# EasyEDA Pro project 3SE_24_Power_Rune.eprj, board 深大PCB参考 (continued)
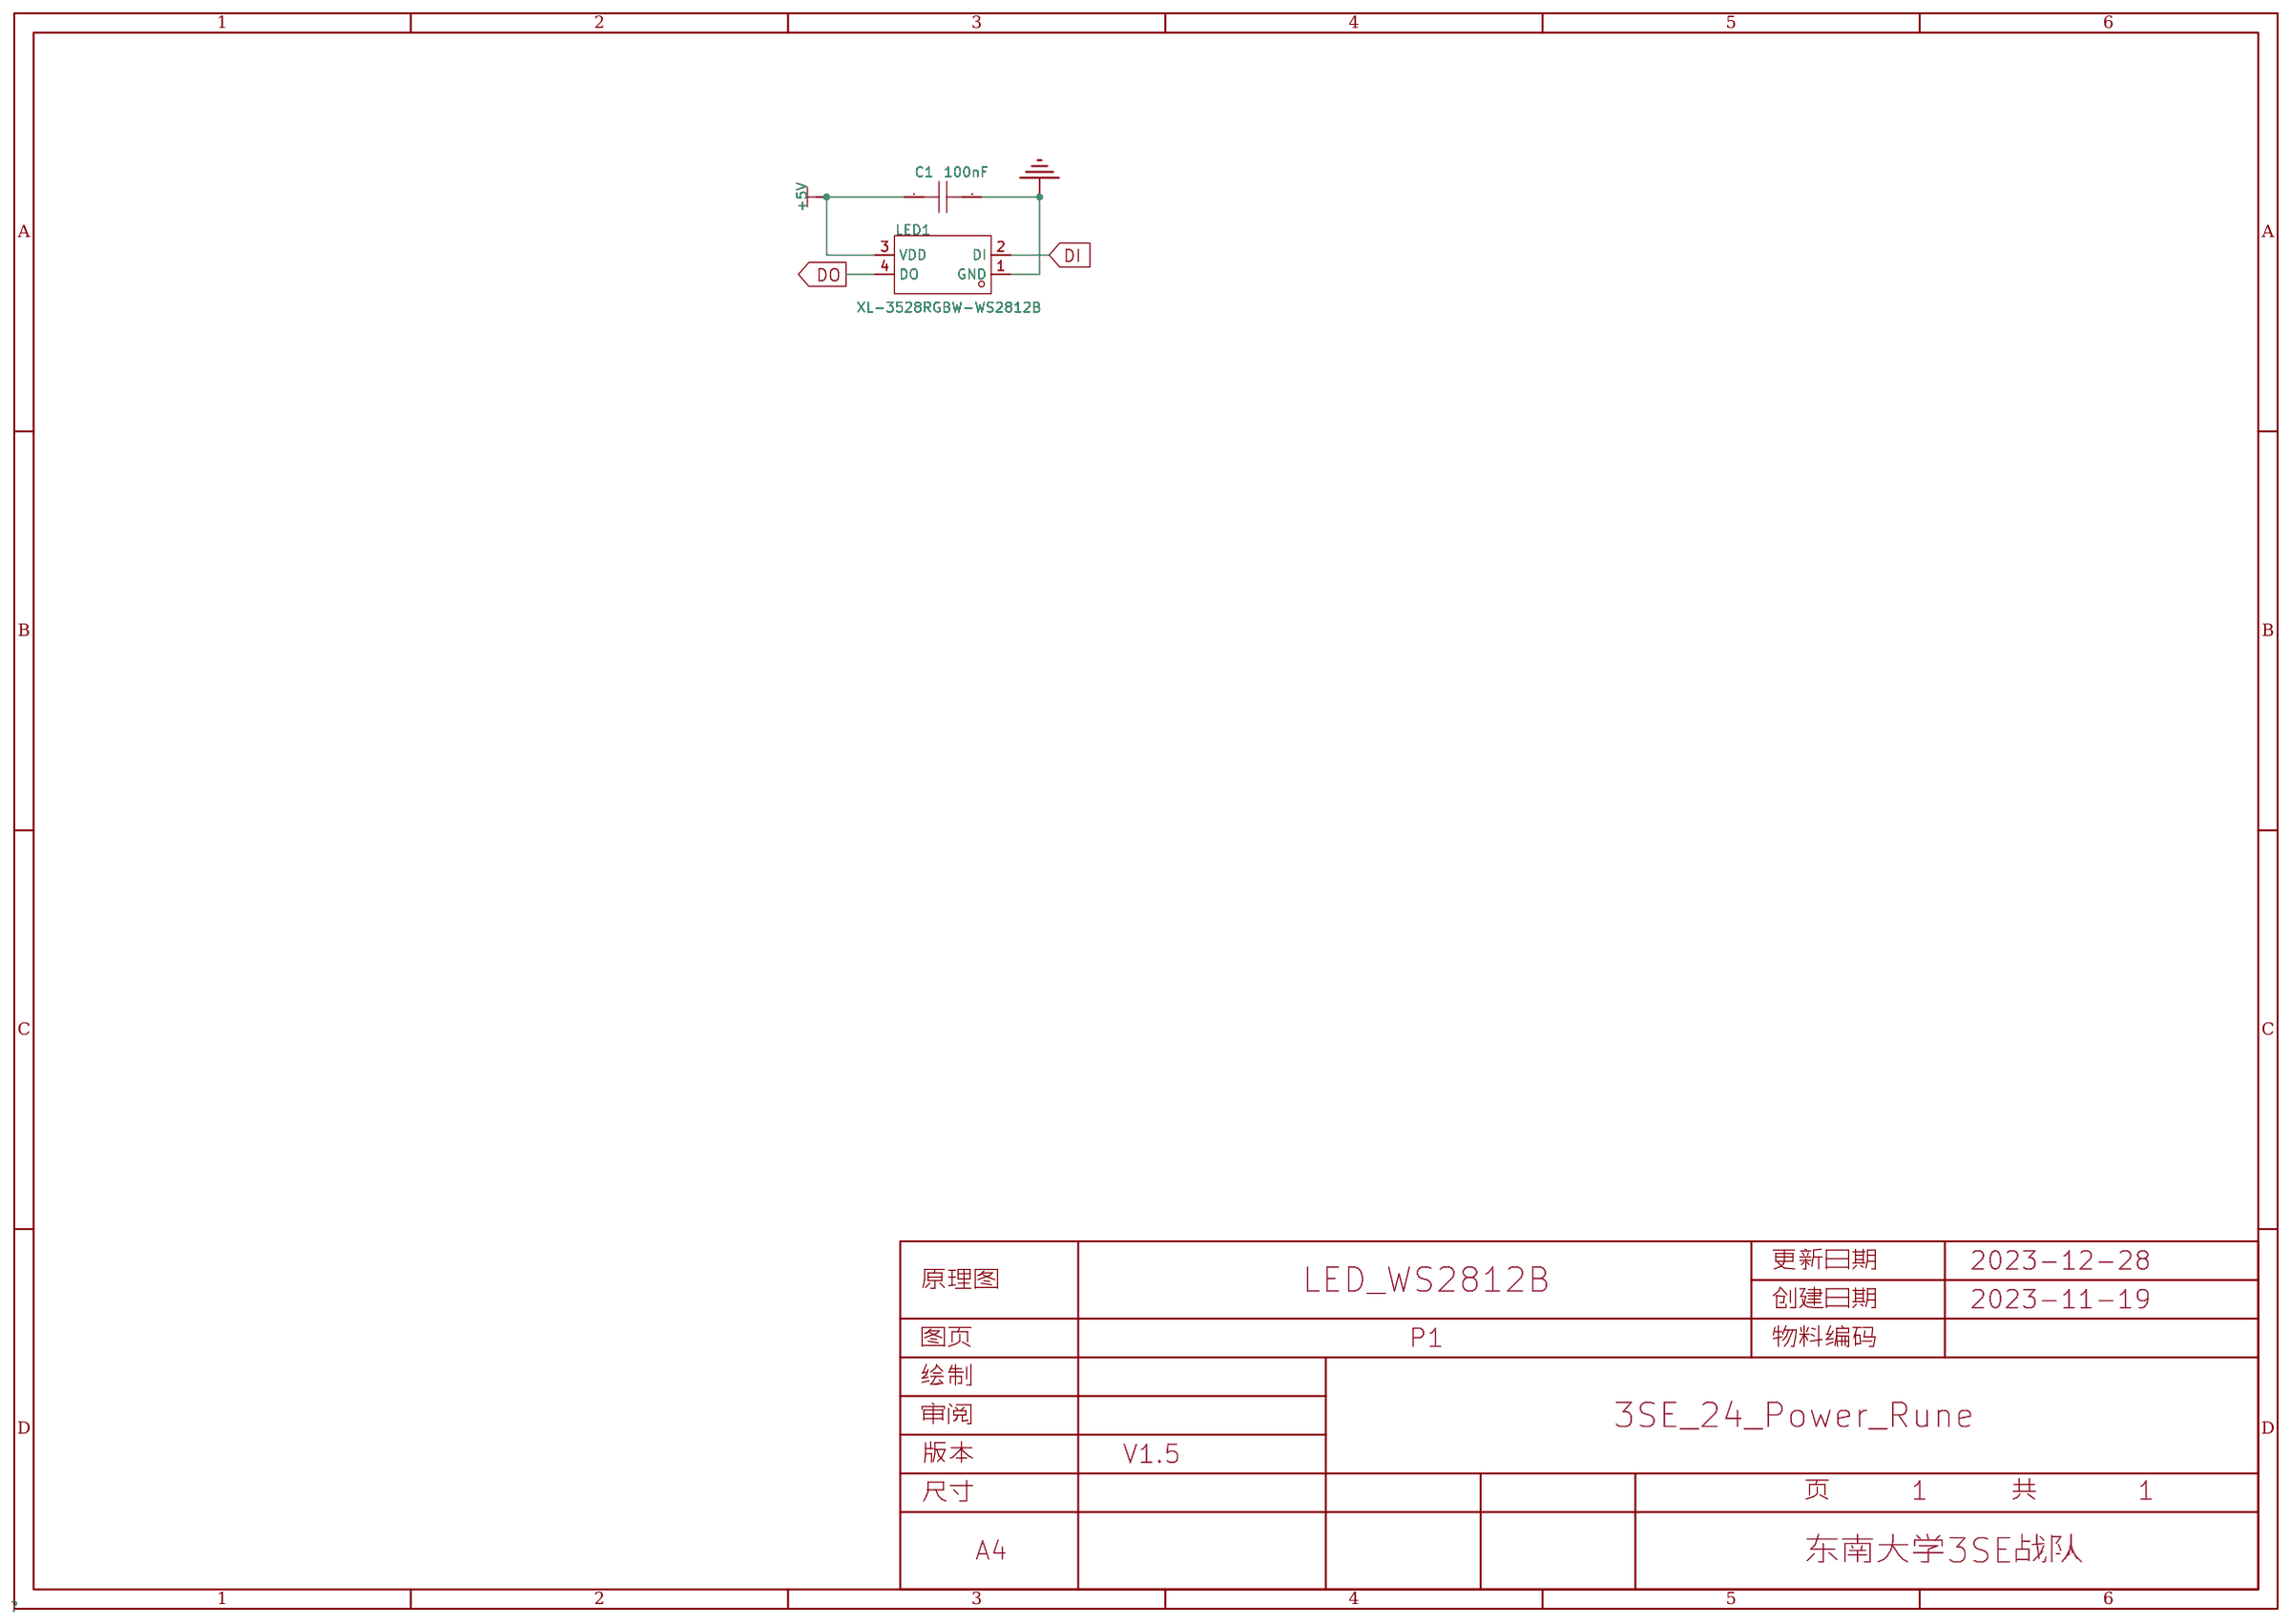
[diagram p0: schematic sheet]
## Routing (per net, layer and track width the routed paths; a pad name or vN(x,y) marks a point on that pad's centre or on a via; arc(x,y) is an arc through that point) (continued)
NETD235_2: length 15.8
  Top Layer w0.254: 73.91,122.18 74.63,122.19 85.65,113.04 D236.4
NETD236_2: length 18.8
  Top Layer w0.381: 84.73,107.48 84.9,107.64 94.29,107.64 98.5,103.43 98.5,100.45 D237.4
NETD237_2: length 15.8
  Top Layer w0.254: D238.4 111.31,88.89 98.2,94.65 D237.2
NETD238_2: length 15.8
  Top Layer w0.254: D239.4 126.41,79.72 112.62,83.6 D238.2
NETD239_2: length 17.4
  Top Layer w0.254: 144.86,73.33 144.31,72.85 128.45,74.66 D239.2
NETD240_2: length 17.3
  Top Layer w0.254: 146.48,67.65 147.03,68.12 162.92,67.81 D241.4
NETD241_2: length 17.5
  Top Layer w0.254: D242.4 182.25,65.07 166.27,63.51 D241.2
NETD242_2: length 11.2
  Top Layer w0.254: D242.2 186.3,61.42 194.87,66.08 D243.4
NETD243_2: length 18.7
  Top Layer w0.254: D244.4 216.82,64.01 199.35,62.17 D243.2
NETD244_2: length 10.4
  Top Layer w0.254: D245.4 229.24,73.85 221.9,68.79 D244.2
NETD245_2: length 15.9
  Top Layer w0.254: 245.38,82.07 245.37,81.34 234.36,71.98 D245.2
NETD246_2: length 15.6
  Top Layer w0.254: 260.06,91.51 260.14,90.79 250.7,80.2 250.69,79.48
NETD247_2: length 24.3
  Top Layer w0.254: D248.4 278.48,104.48 278.49,104.45 278.54,102.57 arc(278.16,100.64) 276.97,99.08 265.96,89.92 D247.2
NETD248_2: length 9.6
  Top Layer w0.254: D249.4 285.18,115.6 283.14,107.76 D248.2
NETD249_2: length 15.8
  Top Layer w0.254: D249.2 290.51,116.72 294.87,130.37 D250.4
NETD250_2: length 15.8
  Top Layer w0.254: D251.4 302.41,146.34 300,132.22 D250.2
NETD251_2: length 15.8
  Top Layer w0.254: D251.2 307.23,148.89 307.65,163.21 D252.4
NETD252_2: length 24.9
  Top Layer w0.254: D252.2 312.07,166.41 311.35,189.87 D253.4
NETD253_2: length 13.5
  Top Layer w0.254: 315.63,193.55 315.01,193.92 309.6,204.74 D254.4
NETD254_2: length 18.2
  Top Layer w0.254: D254.2 314.2,209.12 313.94,225.84 D255.4
NETD255_2: length 9.1
  Top Layer w0.254: D256.4 303.27,235.85 309.16,230.92 D255.2
NETD256_2: length 12.9
  Top Layer w0.254: D256.2 305.32,240.91 297.5,249.22 D257.4
NETD257_2: length 15.8
  Top Layer w0.254: D258.4 288.47,264.41 298.82,254.51 D257.2
NETD258_2: length 12.9
  Top Layer w0.254: D258.2 289.05,269.83 278.95,275.29 D259.4
NETD259_2: length 23
  Top Layer w0.254: D259.2 279.65,281 279.75,281.1 279.75,283.9 272.84,291.37 272.83,291.37 272.8,291.41 270.35,292.49 270.25,292.49 270.2,292.47 D260.4
NETD260_2: length 15.8
  Top Layer w0.254: 264.29,295.92 263.62,295.66 250.13,300.49 D261.4
NETD261_2: length 15.8
  Top Layer w0.254: 249.09,306.03 248.45,305.68 234.43,308.58 D262.4
NETD262_2: length 15.8
  Top Layer w0.254: D262.2 232.05,313.49 217.75,314.41 217.24,313.9
NETD263_2: length 15.8
  Top Layer w0.254: D263.2 214.71,318.94 200.43,317.86 D264.4
NETD264_2: length 12
  Top Layer w0.254: D265.4 186.55,319.23 196.79,321.92 D264.2
NETD265_2: length 19.2
  Top Layer w0.254: D265.2 182.51,322.88 165.63,317.45 D266.4
NETD266_2: length 10.9
  Top Layer w0.254: D267.4 151.36,320.8 160.8,321.57 D266.2
NETD267_2: length 18.4
  Top Layer w0.254: D268.4 131.78,307.22 146.27,316.02 D267.2
NETD268_2: length 16
  Top Layer w0.254: D269.4 115.95,298.77 126.54,308.73 D268.2
NETD269_2: length 15.8
  Top Layer w0.254: D270.4 101.8,288.21 110.55,299.54 D269.2
NETD270_2: length 18.4
  Top Layer w0.254: 89.48,275.09 88.18,278.86 88.17,278.9 88.17,278.97 89.66,284.98 89.72,285.04 94.15,289.03 94.26,289.03 D270.2
NETD271_2: length 15.8
  Top Layer w0.254: 83.61,275.71 83.85,275.02 78.55,261.72 D272.4
NETD272_2: length 15.8
  Top Layer w0.254: 70.33,245.71 69.92,246.31 73.31,260.22 D272.2
NETD273_2: length 15.8
  Top Layer w0.254: 64.51,244.69 64.93,244.1 64.04,229.79 64.53,229.26
NETD274_2: length 15.7
  Top Layer w0.254: 58.91,227.44 59.41,226.91 59.46,212.65 D275.4
NETD275_2: length 25.4
  Top Layer w0.254: D276.4 74.22,194.56 55.27,209.15 D275.2
NETD276_2: length 14
  Top Layer w0.254: D276.2 70.56,190.51 74.68,177.92
NETD277_2: length 13.4
  Top Layer w0.254: 70.8,160.82 71,161.52 69.78,173.42 D277.2
NETD278_2: length 15.6
  Top Layer w0.254: D279.4 83.82,144.8 75.77,156.43 D278.2
NETD279_2: length 15.6
  Top Layer w0.254: D280.4 92.52,129.68 82.4,139.54 D279.2
NETD280_2: length 26.4
  Top Layer w0.254: D281.4 109.49,110.83 109.48,110.79 109.41,110.72 104.7,109.35 arc(103.02,109.38) 101.65,110.37 91.45,123.89 D280.2
NETD281_2: length 13.2
  Top Layer w0.254: D281.2 109.36,105.74 120.85,103.38 121.52,103.66
NETD282_2: length 11.3
  Top Layer w0.254: D283.4 131.49,95.38 121.97,98.04 121.31,97.76
NETD283_2: length 15.2
  Top Layer w0.254: 132.82,89.91 133.43,90.29 146.99,87.75 147.54,88.23
NETD284_2: length 15.6
  Top Layer w0.254: D285.4 163.84,83.21 149.71,83.02 149.16,82.55
NETD285_2: length 16.8
  Top Layer w0.254: D286.4 182.38,81.46 167.27,78.97 D285.2
NETD286_2: length 14.9
  Top Layer w0.254: D286.2 186.43,77.8 199.11,82.14 199.38,82.82
NETD287_2: length 13.3
  Top Layer w0.254: 203.4,78.49 203.87,77.94 215.68,79.25 D288.4
NETD288_2: length 15.7
  Top Layer w0.254: D288.2 220.76,84.03 232.48,92.08 232.53,92.8
NETD289_2: length 17
  Top Layer w0.381: 248.81,102.23 248.89,101.6 237.72,90.57 D289.2
NETD290_2: length 22
  Top Layer w0.381: D291.4 264.94,117.53 263.23,117.22 arc(263.13,117.19) 263.04,117.13 260.16,114.48 arc(260.1,114.42) 260.06,114.35 254.28,100.84 D290.2
NETD291_2: length 10.3
  Top Layer w0.381: D291.2 271.18,116.83 273.29,125.64 D292.4
NETD292_2: length 14.5
  Top Layer w0.381: 281.55,139.93 281.91,139.4 278.65,126.59 278.92,126.01
NETD293_2: length 15.6
  Top Layer w0.381: D294.4 289.02,155.33 287.06,141.18 D293.2
NETD294_2: length 15.6
  Top Layer w0.381: 293.05,172.56 293.55,172.17 293.83,157.89 D294.2
NETD295_2: length 15.6
  Top Layer w0.381: D296.4 295.39,189.51 297.9,175.45 298.4,175.06
NETD296_2: length 15.7
  Top Layer w0.381: 293.88,207.28 294.48,207.06 299.17,193.43 D296.2
NETD297_2: length 11.6
  Top Layer w0.381: 298.2,211.31 298.7,211.7 297.98,221.98 D298.4
NETD298_2: length 17.2
  Top Layer w0.381: D299.4 284.65,240.29 293.24,226.94 D298.2
NETD299_2: length 15.6
  Top Layer w0.381: D299.2 286.24,245.5 275.94,255.4 D300.4
NETD300_2: length 10.5
  Top Layer w0.381: D300.2 276.7,260.79 268.29,264.56 D301.4
NETD301_2: length 24.8
  Top Layer w0.381: D301.2 269.48,270.55 269.58,270.65 270.14,272.59 270.14,272.76 arc(267.44,275.79) 263.95,277.88 254.51,281.74 254.35,281.74 254.27,281.7 D302.4
NETD302_2: length 15.6
  Top Layer w0.381: D302.2 251.08,286.01 237.41,290.16 D303.4
NETD303_2: length 15.6
  Top Layer w0.381: D303.2 235.63,295.31 221.48,297.27 D304.4
NETD304_2: length 15.5
  Top Layer w0.381: D305.4 204.71,301.86 218.92,302.08 219.39,302.52
NETD305_2: length 16.3
  Top Layer w0.381: D306.4 186.62,303.8 201.43,306.21 D305.2
NETD306_2: length 15
  Top Layer w0.381: 183.01,308.14 182.7,307.58 169.88,302.75 169.66,302.15
NETD307_2: length 11.4
  Top Layer w0.381: 154.47,307.03 155.09,306.87 165.24,306.98 D307.2
NETD308_2: length 17.7
  Top Layer w0.381: 150.59,302.57 150.13,302.13 136.52,292.9 D309.4
NETD309_2: length 15.6
  Top Layer w0.381: D309.2 131.31,294.49 121.41,284.2 D310.4
NETD310_2: length 11
  Top Layer w0.381: D311.4 111.43,276.4 116.02,284.95 115.94,285.59
NETD311_2: length 21.2
  Top Layer w0.381: D312.4 95.73,261.21 95.69,261.28 95.69,261.45 101.65,274.34 101.72,274.41 105.19,276.99 105.34,276.99 105.37,276.98 D311.2
NETD312_2: length 15.6
  Top Layer w0.381: D313.4 86.64,245.66 90.8,259.34 D312.2
NETD313_2: length 15.6
  Top Layer w0.381: 81.14,244.42 81.5,243.89 79.54,229.74 D314.4
NETD314_2: length 15.6
  Top Layer w0.381: D315.4 75,212.89 74.73,227.18 D314.2
NETD315_2: length 24.6
  Top Layer w0.381: D316.4 88.25,194.24 70.66,209.61 70.15,210.01
NETD316_2: length 14.3
  Top Layer w0.381: D316.2 84.47,190.32 89.49,178.33 D317.4
NETD317_2: length 9.4
  Top Layer w0.381: D317.2 85.37,173.6 84.41,165.5 D318.4
NETD318_2: length 19.9
  Top Layer w0.381: 88.72,161 89.16,160.54 100.46,145.78 D319.4
NETD319_2: length 15.4
  Top Layer w0.381: D319.2 99.22,140.48 110.12,131.5 D320.4
NETD320_2: length 18
  Top Layer w0.381: D321.4 120.53,118.49 120.46,118.46 120.37,118.46 113.23,119.26 113.12,119.36 108.98,124.1 108.98,124.28 108.98,124.3 D320.2
NETD321_2: length 15.4
  Top Layer w0.381: 122.28,113.52 122.87,113.76 136.23,109.18 D322.4
NETD322_2: length 16.2
  Top Layer w0.381: D323.4 152.72,102.53 137.89,103.99 D322.2
NETD323_2: length 14.5
  Top Layer w0.381: D324.4 168.51,97.46 155.28,97.72 154.81,97.28
NETD324_2: length 12.3
  Top Layer w0.381: 171.51,92.68 171.89,93.19 182.44,96.25 D325.4
NETD325_2: length 14.4
  Top Layer w0.381: D325.2 186.36,92.47 198.79,96.82 D326.4
NETD326_2: length 18.3
  Top Layer w0.381: D327.4 218.5,102.27 203.55,94.19 D326.2
NETD327_2: length 13.6
  Top Layer w0.381: 223.52,99.7 223.58,100.33 232.65,108.7 D328.4
NETD328_2: length 14.6
  Top Layer w0.381: D329.4 246.2,118.25 238.01,107.71 D328.2
NETD329_2: length 20.8
  Top Layer w0.381: D329.2 254.6,117.7 254.74,117.71 257.62,120.46 257.68,120.53 260.91,130.72 260.91,130.86 260.88,130.94 259.65,133.56
NETD330_2: length 15.7
  Top Layer w0.381: D331.4 269.85,147.62 265.29,133.93 D330.2
NETD331_2: length 21
  Top Layer w0.381: 276.87,169.54 277.33,169.09 274.95,149.51 D331.2
NETD332_2: length 19.8
  Top Layer w0.381: D333.4 280.56,190.32 282.02,171.86 D332.2
NETD333_2: length 10.9
  Top Layer w0.381: 279.39,203.12 279.98,202.86 284.34,194.24 D333.2
NETD334_2: length 12.2
  Top Layer w0.381: 283.98,206.84 284.51,207.2 283.63,218.04 283.79,218.66
NETD335_2: length 11.4
  Top Layer w0.381: D335.2 278.89,223 272.68,231.04 D336.4
NETD336_2: length 15.7
  Top Layer w0.381: D337.4 264.57,246.84 274.39,236.21 D336.2
NETD337_2: length 27.2
  Top Layer w0.381: 265.96,252.31 265.33,252.23 254.98,266.21 arc(254.88,266.3) 254.76,266.35 252.95,266.8 arc(252.86,266.81) 252.76,266.8 246.75,265.13 D338.4
NETD338_2: length 14
  Top Layer w0.381: D339.4 234.27,273.82 246.53,270.57 D338.2
NETD339_2: length 15.7
  Top Layer w0.381: D339.2 233.09,279.14 218.86,281.46 D340.4
NETD340_2: length 15.6
  Top Layer w0.381: D341.4 202.4,286.28 216.75,286.48 D340.2
NETD341_2: length 14.6
  Top Layer w0.381: 199.85,291.32 199.42,290.84 186.36,288.18 D342.4
NETD342_2: length 9.7
  Top Layer w0.381: D343.4 175,287.97 182.44,291.96 D342.2
NETD343_2: length 13.5
  Top Layer w0.381: D344.4 158.26,292.4 170.46,292.3 D343.2
NETD344_2: length 15.8
  Top Layer w0.381: D345.4 141.99,278.48 153.3,287.65 D344.2
NETD345_2: length 15.4
  Top Layer w0.381: 136.75,280.59 136.75,279.95 127.28,269.47 D346.4
NETD346_2: length 19.9
  Top Layer w0.381: D347.4 115.07,255.09 115.11,255.08 115.29,255.08 119.31,258.51 119.39,258.59 122.24,267.64 122.24,267.73 122.24,267.76 D346.2
NETD347_2: length 13.1
  Top Layer w0.381: D348.4 103.82,244.39 107.65,255.61 107.44,256.21
NETD348_2: length 15.4
  Top Layer w0.381: D348.2 98.56,242.97 95.81,229.12 D349.4
NETD349_2: length 15.4
  Top Layer w0.381: 91.16,212.26 90.66,212.66 90.89,226.78 90.48,227.26
NETD350_2: length 23.8
  Top Layer w0.381: D351.4 102.98,194.36 86.24,209.48 D350.2
NETD351_2: length 17.6
  Top Layer w0.381: D352.4 98,174.14 98.08,190.45 D351.2
NETD352_2: length 12.5
  Top Layer w0.381: D353.4 109.41,161.29 107.23,161.41 arc(107.05,161.46) 106.92,161.6 102.75,169.18 D352.2
NETD353_2: length 15.3
  Top Layer w0.381: D354.4 117.61,146.34 107.55,156.17 D353.2
NETD354_2: length 19.7
  Top Layer w0.381: D355.4 131.86,132.7 132.1,132.95 132.1,133.58 127.96,137.72 127.88,137.75 118.55,141.14 118.46,141.14 118.44,141.14 D354.2
NETD355_2: length 12.5
  Top Layer w0.381: D355.2 131.64,126.57 142.3,123.08 142.84,123.41
NETD357_2: length 11.6
  Top Layer w0.381: 158.17,112.1 158.63,112.53 168.94,113.08 169.3,113.61
NETD358_2: length 11.5
  Top Layer w0.381: D359.4 182.44,110.86 172.44,108.91 172.07,108.39
NETD359_2: length 21
  Top Layer w0.381: D359.2 186.36,107.08 206.1,108.04 D360.4
NETD360_2: length 16.6
  Top Layer w0.381: 210.6,112.34 211.06,112.78 223.85,121.25 D361.4
NETD361_2: length 11.7
  Top Layer w0.381: D361.2 229.13,119.93 235.22,128.41 D362.4
NETD362_2: length 21.7
  Top Layer w0.381: D363.4 250.69,140.94 250.73,140.86 250.73,140.71 247.4,131.07 247.33,131.01 243.41,127.47 243.25,127.47 243.24,127.47 D362.2
NETD363_2: length 15.3
  Top Layer w0.381: D363.2 254.92,144.32 258.41,157.94 D364.4
NETD364_2: length 15.3
  Top Layer w0.381: 263.84,159.48 263.46,159.99 264.04,174.04 D365.4
NETD365_2: length 14.8
  Top Layer w0.381: D366.4 266.21,190.45 268.56,177.09 269.04,176.67
NETD366_2: length 14.4
  Top Layer w0.381: 271.6,208.12 271.44,207.5 271.11,194.36 270.55,194.06
NETD367_2: length 13.8
  Top Layer w0.381: D368.4 259.9,223.03 266.7,212.46 D367.2
NETD368_2: length 16.2
  Top Layer w0.381: D369.4 251.71,239.24 261.76,228.14 D368.2
NETD369_2: length 24.6
  Top Layer w0.381: 252.46,244.63 D369.2 252.92,244.96 245.69,254.91 arc(245.61,255) 245.49,255.05 ; 245.49,255.05 240.84,256.4 arc(240.79,256.41) 240.74,256.41 236.83,256.41 arc(235.84,256) D370.4
NETD370_2: length 16.3
  Top Layer w0.381: 222.49,263.19 D371.4 233.2,262.86 arc(234.17,262.67) 234.99,262.12 D370.2 235.65,260.65
NETD371_2: length 18.3
  Top Layer w0.381: D371.2 220.99,268.43 204.23,271.15 D372.4
NETD372_2: length 16.8
  Top Layer w0.381: D372.2 201.67,275.96 186.36,273.66 D373.4
NETD373_2: length 7.9
  Top Layer w0.381: 182.75,278 182.45,277.44 177.03,273.66 D374.4
NETD374_2: length 11.4
  Top Layer w0.381: D374.2 172.67,277.61 162.33,276.52 D375.4
NETD375_2: length 15.7
  Top Layer w0.381: 157.83,272.22 157.37,271.78 145.4,263.78 145.42,263.14
NETD376_2: length 13
  Top Layer w0.381: D377.4 132.9,255.81 140.12,265.1 D376.2
NETD377_2: length 18.6
  Top Layer w0.381: D378.4 118.99,243.85 118.96,243.92 118.96,244.07 121.64,252.16 121.71,252.23 121.72,252.23 126.63,256.65 126.78,256.65 126.79,256.65 D377.2
NETD378_2: length 15.3
  Top Layer w0.381: D378.2 114.4,241.25 110.91,227.63 D379.4
NETD379_2: length 15.3
  Top Layer w0.381: D380.4 105.27,211.53 105.86,225.59 105.47,226.1
NETD380_2: length 24.1
  Top Layer w0.381: 100.28,208.91 100.76,208.49 118.68,194.36 D381.4
NETD381_2: length 18.5
  Top Layer w0.381: D381.2 113.88,190.44 113.88,173.12 D382.4
NETD382_2: length 10.5
  Top Layer w0.381: 118.18,168.62 118.62,168.16 125.8,162.43 126.44,162.43
NETD383_2: length 10.8
  Top Layer w0.381: D384.4 132.49,152.17 124.38,157.17 D383.2
NETD384_2: length 21.5
  Top Layer w0.381: D384.2 131.28,144.94 131.26,144.89 131.26,144.71 133.93,140.88 134.02,140.79 146.12,137.26 146.27,137.26 146.36,137.31 D385.4
NETD385_2: length 14.8
  Top Layer w0.381: D385.2 148.72,132.61 162.11,130.39 D386.4
NETD386_2: length 14.9
  Top Layer w0.381: D387.4 178.2,126.79 164.67,125.58 D386.2
NETD387_2: length 13.7
  Top Layer w0.381: D387.2 181.87,122.77 193.49,127.22 D388.4
NETD388_2: length 13.9
  Top Layer w0.381: D389.4 210.8,124.8 198.26,123.14 D388.2
NETD389_2: length 15.3
  Top Layer w0.381: D390.4 224.71,140.28 215.76,129.54 215.3,129.1
NETD390_2: length 18.5
  Top Layer w0.381: 236.6,152.65 237.87,149.93 237.91,149.86 237.91,149.74 236.6,142.26 236.51,142.16 232.28,138.67 232.09,138.67 232.03,138.68 D390.2
NETD391_2: length 14.6
  Top Layer w0.381: D391.2 242.23,153.02 244.77,166.12 D392.4
NETD392_2: length 14.9
  Top Layer w0.381: D392.2 249.73,168.37 249.37,181.95 D393.4
NETD393_2: length 15.1
  Top Layer w0.381: D393.2 253.62,185.36 249.13,198.39 D394.4
NETD394_2: length 10.6
  Top Layer w0.381: D395.4 254.3,212.2 253.5,202.89 252.99,202.52
NETD395_2: length 17.4
  Top Layer w0.381: D396.4 238.83,229.21 249.55,217.16 D395.2
NETD396_2: length 22.8
  Top Layer w0.381: D396.2 240.49,235.26 236.41,244.32 arc(236.31,244.45) 236.18,244.53 ; 236.18,244.53 231.75,245.97 arc(231.65,245.99) 231.55,245.98 225.27,244.63 224.67,244.4
NETD397_2: length 11.7
  Top Layer w0.381: D397.2 224.66,250.04 214.3,250.86 213.78,250.48
NETD398_2: length 14.9
  Top Layer w0.381: D398.2 212.37,255.95 198.78,257.29 D399.4
NETD399_2: length 11.1
  Top Layer w0.381: D400.4 186.61,257.82 195.64,261.73 D399.2
NETD400_2: length 18.2
  Top Layer w0.381: D400.2 182.39,262.47 165.5,261.66 D401.4
NETD401_2: length 13.8
  Top Layer w0.381: D401.2 160.54,256.92 150.96,248.89 151,248.25
NETD402_2: length 20.2
  Top Layer w0.381: D403.4 138.21,234.85 138.37,234.85 138.48,234.97 140.97,237.62 145.78,247.33 145.78,247.43 145.78,247.44 D402.2
NETD403_2: length 11.1
  Top Layer w0.381: D404.4 127.82,225.77 130.5,235.2 D403.2
NETD404_2: length 14.9
  Top Layer w0.381: D405.4 121.26,210.64 122.62,224.16 D404.2
NETD405_2: length 22.7
  Top Layer w0.381: 133.72,193.8 133.16,194.11 116.63,207.79 D405.2
NETD406_2: length 14.6
  Top Layer w0.381: D406.2 128.86,190.19 128.86,176.55 128.71,175.93
NETD407_2: length 12.9
  Top Layer w0.381: D408.4 141.99,163.51 133.61,171.59 D407.2
NETD408_2: length 17.7
  Top Layer w0.381: 147.05,158.96 149.32,159.09 149.49,159.09 149.61,158.96 149.62,158.95 153.8,153.83 153.8,153.67 153.79,153.65 D409.4 ; D408.2 141.02,158.42 141.07,158.45 143.47,158.75 147.05,158.96
NETD409_2: length 14.7
  Top Layer w0.381: D409.2 153.96,146.38 167.13,143.95 D410.4
NETD410_2: length 14.7
  Top Layer w0.381: D411.4 182.96,140.9 169.69,139.14 D410.2
NETD411_2: length 14.3
  Top Layer w0.381: D411.2 186.88,136.99 200,136.99 D412.4
NETD412_2: length 13
  Top Layer w0.381: 213.48,150.38 213.55,149.74 204.96,141.74 204.5,141.29
NETD413_2: length 17.4
  Top Layer w0.381: D414.4 226.51,158.21 226.55,158.14 226.55,158.04 226.19,153.07 226.07,152.95 219.84,148.26 219.68,148.26 219.66,148.26 D413.2
NETD414_2: length 14.7
  Top Layer w0.381: D414.2 230.69,161.71 233.11,174.87 232.68,175.34
NETD415_2: length 14.7
  Top Layer w0.381: D416.4 236.16,190.71 237.92,177.43 D415.2
NETD416_2: length 14
  Top Layer w0.381: D417.4 239.82,207.37 239.94,194.62 240.5,194.31
NETD417_2: length 13.1
  Top Layer w0.381: D417.2 235.07,212.33 227.32,221.3 226.69,221.22
NETD418_2: length 19.1
  Top Layer w0.381: D419.4 220.56,235.11 220.64,235.14 220.74,235.14 225.53,234.7 225.64,234.59 229.09,230.28 229.09,230.12 229.08,230.1 228.71,226.77
NETD419_2: length 15.1
  Top Layer w0.381: 216.36,238.95 216.23,238.91 215.79,238.68 202.19,240.86 D420.4
NETD420_2: length 14.7
  Top Layer w0.381: D420.2 199.63,245.67 186.36,243.91 D421.4
NETD421_2: length 14.3
  Top Layer w0.381: 182.75,248.25 182.44,247.69 169.44,247.31 168.82,247.47
NETD422_2: length 12.8
  Top Layer w0.381: D423.4 155.76,235.07 164.48,242.57 164.94,243.01
NETD423_2: length 18.4
  Top Layer w0.381: 144.65,223.39 146.96,223.11 146.99,223.1 147.14,223.1 151.74,226.87 151.75,226.88 151.87,227 151.87,227.18 150.78,236.06 150.67,236.16 150.65,236.18 D423.2
NETD424_2: length 14.7
  Top Layer w0.381: 138.75,223.6 139.02,223.02 136.2,209.94 136.64,209.47
NETD425_2: length 22.4
  Top Layer w0.381: 130.96,207.85 131.4,207.38 148.4,194.87 D426.4
NETD426_2: length 12.4
  Top Layer w0.381: 143.95,178.98 143.88,179.04 143.88,191.09 144.06,191.26
NETD427_2: length 19.1
  Top Layer w0.381: 162.07,166.77 162.18,166.65 162.18,165.01 162.97,164.22 ; D427.2 148.59,175.15 148.9,175.15 160.78,168.02 160.81,167.99 162.06,166.77
NETD428_2: length 11.2
  Top Layer w0.381: 173.05,159.05 173.01,159.05 172.5,158.53 162.31,158.53 162.15,158.37
NETD429_2: length 12
  Top Layer w0.381: 185.84,156.76 185.59,156.17 175.14,153.81 D429.2
NETD430_2: length 7.9
  Top Layer w0.381: D431.4 196.58,151.22 190,151.71 D430.2
NETD431_2: length 22.5
  Top Layer w0.381: 201.08,155.52 201.54,155.96 205.45,162.24 arc(205.48,162.31) 205.5,162.38 206.07,165.9 206.29,167.27 206.31,167.39 210.3,171.51 210.4,171.61 210.53,171.62 211.74,171.76 213.11,171.91 213.74,171.83
NETD432_2: length 11.2
  Top Layer w0.381: D433.4 220.95,181.95 219.37,172.2 D432.2
NETD433_2: length 9.3
  Top Layer w0.381: D433.2 225.47,185 220.8,191.55 D434.4
NETD434_2: length 9.8
  Top Layer w0.381: 224.06,196.16 224.52,196.6 224.96,205.09 D435.4
NETD435_2: length 25.7
  Top Layer w0.381: 220.66,209.58 220.21,210.05 216.09,221.57 arc(216,221.71) 215.86,221.8 209.68,223.86 arc(209.55,223.88) 209.43,223.86 ; 209.43,223.86 204.68,222.16 204.13,221.83
NETD436_2: length 13.5
  Top Layer w0.381: D437.4 190.71,227.6 203.6,227.6 D436.2
NETD437_2: length 15.2
  Top Layer w0.381: D438.4 172.56,232.54 187.6,232.54 D437.2
NETD438_2: length 23.1
  Top Layer w0.381: D439.4 156.25,212.82 162.72,214.81 ; 168.62,228.02 168.16,227.58 165.01,225.9 arc(164.88,225.79) 164.82,225.63 162.98,215.11 arc(162.89,214.93) 162.72,214.82
NETD439_2: length 10
  Top Layer w0.381: D439.2 150.08,214.29 150.08,205.93 150.99,205.02 D440.4
NETD440_2: length 19.5
  Top Layer w0.381: D440.2 145.56,203.32 156.97,189.09 D441.4
NETD441_2: length 17.8
  Top Layer w0.381: D442.4 175.08,174.87 175.08,175.31 169.42,180.98 165.64,180.98 162.38,184.23 162.35,184.23 161.87,184.72 161.87,184.75
NETD442_2: length 15.7
  Top Layer w0.381: 188.43,163.63 187.81,163.79 174.42,169.11 D442.2
NETD443_2: length 18.5
  Top Layer w0.381: 192.31,168.09 192.77,168.53 195.54,171.2 195.54,171.2 195.63,171.3 196.59,178.76 196.7,178.86 196.71,178.87 200.98,182.41 D444.4
NETD444_2: length 17.3
  Top Layer w0.381: D445.4 212.89,196.7 207.21,181.72 D444.2
NETD445_2: length 23.9
  Top Layer w0.381: 207.57,208.37 202.9,213.52 arc(202.81,213.6) 202.69,213.64 200.25,214.1 arc(200.15,214.11) 200.06,214.09 ; 193.64,211.93 194.25,212.1 200.06,214.09 ; D445.2 208.75,201.82 207.66,208.18 arc(207.63,208.28) 207.57,208.37
NETD446_2: length 15.2
  Top Layer w0.381: D446.2 194.16,217.55 180.61,220.89 179.99,221.05
NETD447_2: length 23
  Top Layer w0.381: D447.2 175.57,216.74 175.52,216.76 175.42,216.76 172.67,216.02 172.63,216 164.48,211.34 164.41,211.28 160.83,205.44 160.83,205.28 160.84,205.22 D448.4
NETD448_2: length 12.7
  Top Layer w0.381: D448.2 167.6,201.21 170.14,201.21 176.13,195.21 176.13,193.8
NETD449_2: length 18.3
  Top Layer w0.381: D449.2 171.79,190.19 183.64,178.88 183.88,178.04 183.88,177.98 183.99,177.67
NETD450_2: length 11.4
  Top Layer w0.381: 190.97,189.9 189.45,181.28 188.89,180.97 ; D451.4 192.14,190.43 191.25,190.21 arc(191.07,190.1) 190.97,189.9
NETD451_2: length 20.2
  Top Layer w0.381: 184.73,206.63 188.6,206.63 197.6,197.62 197.6,194.04
R_DET1: length 675.5
  Top Layer w0.381: 151.72,328.98 154.33,326.37 arc(154.84,326.02) 155.45,325.9 arc(255.3,308.91) 315.87,227.72 318.38,225.2 arc(319.21,224.65) 320.18,224.46 321.1,224.46 318.66,222.02 arc(318.11,221.19) 317.92,220.22 317.92,218.8 arc(299.78,120.5) 219.44,61.01 217.2,58.76 arc(216.65,57.94) 216.45,56.97 216.45,56.34 214.65,58.15 arc(213.82,58.7) 212.85,58.89 210.32,58.89 arc(112.06,76.99) 52.53,157.23 50.92,158.85 arc(50.09,159.4) 49.12,159.59 47.2,159.59
  Bottom Layer w0.381: 321.1,224.46 321.19,224.12 338.41,221.23 J18.1 ; 151.72,328.98 152.31,328.39 arc(152.84,327.58) J13.1
R_DET2: length 622.5
  Top Layer w0.381: 155.15,314.5 157.82,311.82 ; 61.68,163.4 61.94,163.4 arc(62.17,163.45) 62.36,163.58 63.31,163.58 arc(64.28,163.38) 65.11,162.83 66.05,161.89 arc(119.81,88.8) 209.16,72.96 209.58,72.96 arc(210.55,72.77) 211.38,72.21 213.02,70.57 213.02,71.01 arc(213.22,71.98) 213.77,72.81 215.39,74.43 arc(288.11,128.22) 303.88,217.29 arc(303.96,217.73) 304.22,218.11 307.38,221.28 305.8,221.28 arc(304.83,221.47) 304,222.02 302.38,223.65 arc(247.89,296.79) 157.91,311.79
  Bottom Layer w0.381: 155.15,314.5 155.76,313.88 arc(156.29,313.09) J12.1 ; 307.38,221.28 307.48,220.94 338.41,219.98 J18.2
R_DET3: length 564.6
  Top Layer w0.381: SW27.1 162.53,297.21 arc(163.35,296.65) 164.33,296.45 arc(164.37,296.45) 164.41,296.45 arc(203.97,296.62) 240.87,282.37 arc(269.66,256.02) 286.88,221 289.41,218.47 arc(290.23,217.92) 291.21,217.72 291.64,217.72 290.03,216.12 arc(289.48,215.29) 289.29,214.32 289.29,213.99 arc(275.65,135.22) 211.19,87.94 210.1,86.85 arc(209.57,86.06) 209.39,85.13 208.22,86.3 arc(207.54,86.75) 206.75,86.91 arc(128.63,100.56) 81.42,164.28 79.99,165.71 arc(79.17,166.26) 78.2,166.45 SW28.1
  Bottom Layer w0.381: J11.1 160.12,298.92 159.69,300.05 159.42,300.74 SW27.1 ; 291.64,217.72 291.73,217.39 338.41,217.39 J18.4
R_DET4: length 508.8
  Top Layer w0.381: 90.76,169.88 92.59,169.88 arc(93.56,169.69) 94.39,169.14 95.63,167.89 arc(135.68,114.15) 201.56,101.8 202.58,101.8 arc(203.55,101.61) 204.38,101.06 SW25.1 205.45,100.4 arc(205.64,101.37) 206.19,102.2 207.01,103.01 arc(262.17,142.96) 274.78,209.9 274.78,210.36 arc(274.98,211.33) 275.53,212.16 277.03,213.66 276.71,213.66 arc(275.74,213.85) 274.92,214.4 273.4,215.92 arc(233.11,270.41) 166.45,282.56 arc(165.8,282.69) 165.25,283.06 162.39,285.92
  Bottom Layer w0.381: 162.39,285.92 162.97,285.34 arc(163.51,284.53) J10.1 ; J18.5 338.41,216.01 277.12,213.32 277.03,213.66
R_DET5: length 453.7
  Top Layer w0.381: SW19.1 167.57,268.8 arc(168.39,268.25) 169.37,268.06 170.06,268.06 arc(225.73,257.41) 259.1,211.59 259.84,210.85 arc(260.66,210.3) 261.63,210.1 262.94,210.1 260.64,207.81 arc(260.3,207.31) 260.19,206.73 arc(249.48,150.83) 203.36,117.49 202.64,116.77 arc(202.09,115.95) 201.89,114.97 SW21.1 200.67,115.56 arc(199.84,116.11) 198.87,116.31 197.87,116.31 arc(142.37,127.6) 109.53,173.75 106.51,173.75 arc(106.09,173.67) 105.75,173.44
  Bottom Layer w0.381: SW19.1 166.78,269.59 arc(167.32,268.78) J9.1 ; J18.6 338.41,214.76 263.03,209.77 262.94,210.1
